# EasyEDA Pro project Project_first.eprj, schematic Schematic1
Create Date: 2024-04-23; Page Name: 485_ERR; Project Name: Project_first; Schematic Name: Schematic1; Update Date: 2024-06-17; Company: 嘉立创EDA; Page Size: A4; Version: V1.0
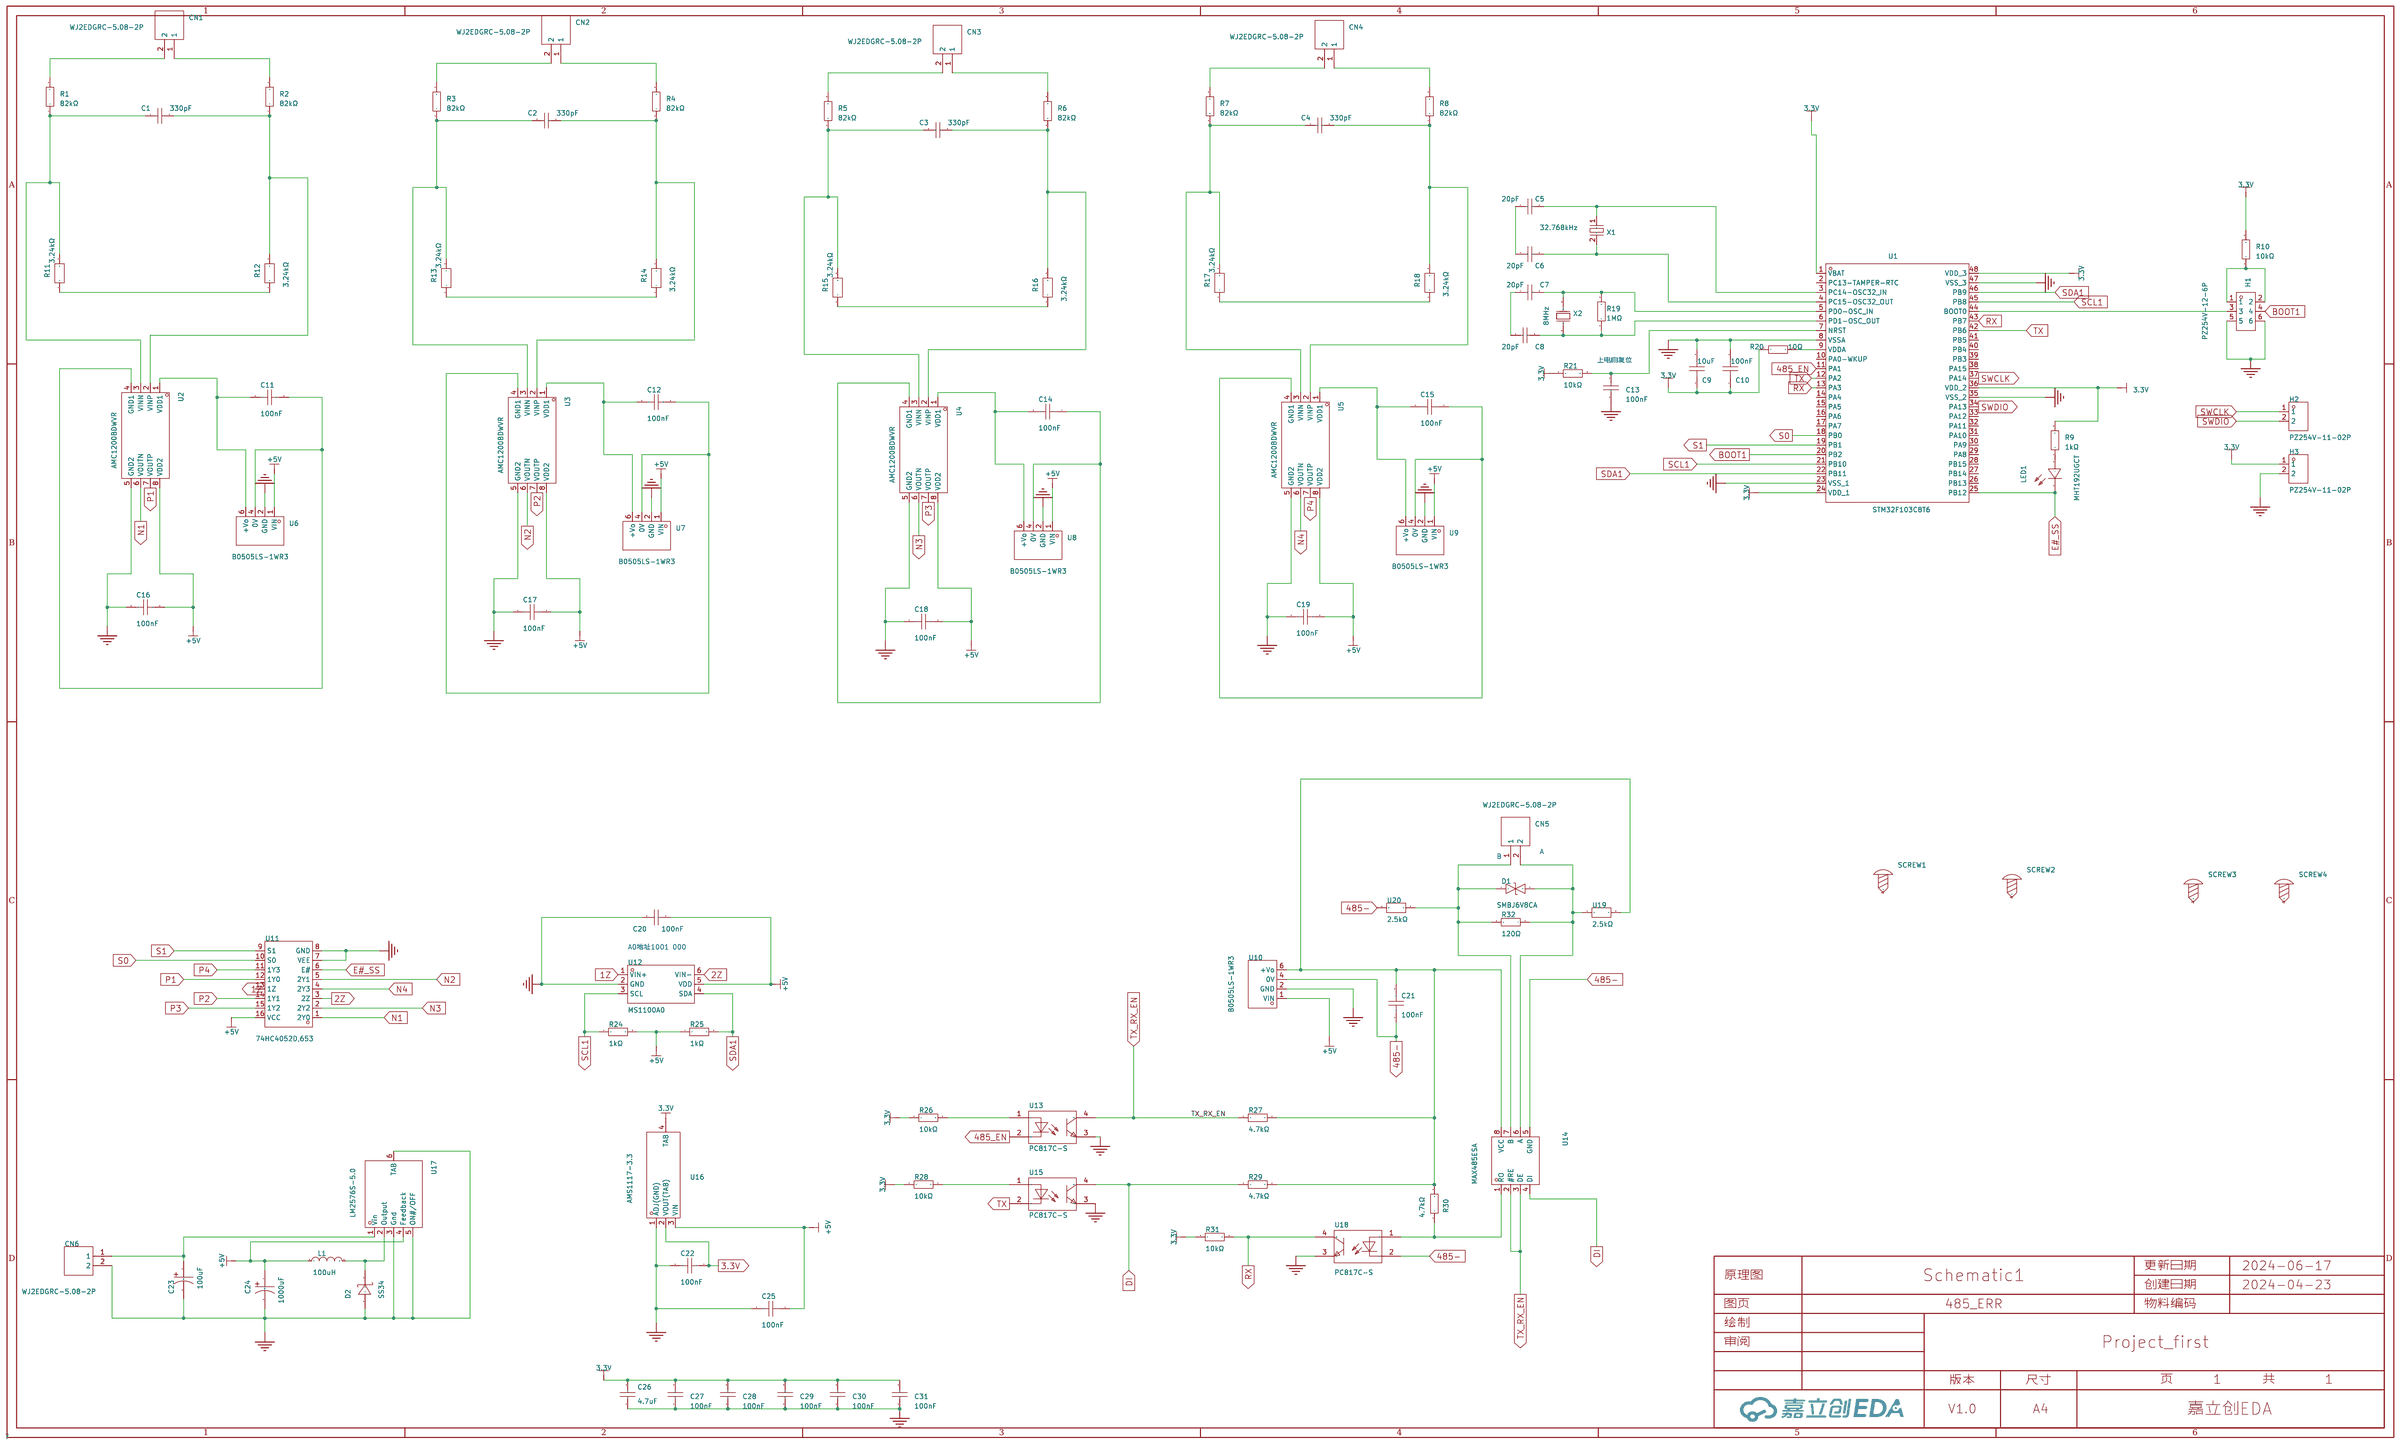
[diagram p0: schematic sheet]

## Parts
C1  330pF  [C0603]
C2  330pF  [C0603]
C3  330pF  [C0603]
C4  330pF  [C0603]
C5  20pF  [C0603]
C6  20pF  [C0603]
C7  20pF  [C0603]
C8  20pF  [C0603]
C9  10uF  [C0603]
C10  100nF  [C0603]
C11  100nF  [C0603]
C12  100nF  [C0603]
C13  100nF  [C0402]
C14  100nF  [C0603]
C15  100nF  [C0603]
C16  100nF  [C0603]
C17  100nF  [C0603]
C18  100nF  [C0603]
C19  100nF  [C0603]
C20  100nF  [C0402]
C21  100nF  [C0603]
C22  100nF  [C0603]
C23  100uF  [CAP-TH_BD8.0-P3.50-D0.6-FD]
C24  1000uF  [CAP-TH_BD10.0-P5.00-D1.0-FD]
C25  100nF  [C0603]
C26  4.7uF  [C0603]
C27  100nF  [C0402]
C28  100nF  [C0402]
C29  100nF  [C0402]
C30  100nF  [C0402]
C31  100nF  [C0402]
CN1  WJ2EDGRC-5.08-2P  [CONN-TH_2P-P5.08_WJ2EDGRC-5.08-2P]
CN2  WJ2EDGRC-5.08-2P  [CONN-TH_2P-P5.08_WJ2EDGRC-5.08-2P]
CN3  WJ2EDGRC-5.08-2P  [CONN-TH_2P-P5.08_WJ2EDGRC-5.08-2P]
CN4  WJ2EDGRC-5.08-2P  [CONN-TH_2P-P5.08_WJ2EDGRC-5.08-2P]
CN5  WJ2EDGRC-5.08-2P  [CONN-TH_2P-P5.08_WJ2EDGRC-5.08-2P]
CN6  WJ2EDGRC-5.08-2P  [CONN-TH_2P-P5.08_WJ2EDGRC-5.08-2P]
D1  SMBJ6V8CA  [SMB_L4.6-W3.6-LS5.3-BI]
D2  SS34  [SMA_L4.3-W2.6-LS5.2-RD]
H1  PZ254V-12-6P  [HDR-TH_6P-P2.54-V-M-R2-C3-S2.54]
H2  PZ254V-11-02P  [HDR-TH_2P-P2.54-V-M]
H3  PZ254V-11-02P  [HDR-TH_2P-P2.54-V-M]
L1  100uH  [IND-SMD_L7.3-W7.3-1]
LED1  MHT192UGCT  [LED0603-RD_GREEN]
R1  82kΩ  [R1206]
R2  82kΩ  [R1206]
R3  82kΩ  [R1206]
R4  82kΩ  [R1206]
R5  82kΩ  [R1206]
R6  82kΩ  [R1206]
R7  82kΩ  [R1206]
R8  82kΩ  [R1206]
R9  1kΩ  [R0805]
R10  10kΩ  [R0805]
R11  3.24kΩ  [R1206]
R12  3.24kΩ  [R1206]
R13  3.24kΩ  [R1206]
R14  3.24kΩ  [R1206]
R15  3.24kΩ  [R1206]
R16  3.24kΩ  [R1206]
R17  3.24kΩ  [R1206]
R18  3.24kΩ  [R1206]
R19  1MΩ  [R0603]
R20  10Ω  [R0603]
R21  10kΩ  [R0805]
R24  1kΩ  [R0805]
R25  1kΩ  [R0805]
R26  10kΩ  [R0805]
R27  4.7kΩ  [R0603]
R28  10kΩ  [R0805]
R29  4.7kΩ  [R0603]
R30  4.7kΩ  [R0603]
R31  10kΩ  [R0805]
R32  120Ω  [R0603]
SCREW1  -  [M3螺丝]
SCREW2  -  [M3螺丝]
SCREW3  -  [M3螺丝]
SCREW4  -  [M3螺丝]
U1  STM32F103C8T6  [LQFP-48_L7.0-W7.0-P0.50-LS9.0-BL]
U2  AMC1200BDWVR  [SOIC-8_L5.9-W7.5-P1.27-LS11.5-BL]
U3  AMC1200BDWVR  [SOIC-8_L5.9-W7.5-P1.27-LS11.5-BL]
U4  AMC1200BDWVR  [SOIC-8_L5.9-W7.5-P1.27-LS11.5-BL]
U5  AMC1200BDWVR  [SOIC-8_L5.9-W7.5-P1.27-LS11.5-BL]
U6  B0505LS-1WR3  [PWRM-TH_BXXXXLS-1WR3]
U7  B0505LS-1WR3  [PWRM-TH_BXXXXLS-1WR3]
U8  B0505LS-1WR3  [PWRM-TH_BXXXXLS-1WR3]
U9  B0505LS-1WR3  [PWRM-TH_BXXXXLS-1WR3]
U10  B0505LS-1WR3  [PWRM-TH_BXXXXLS-1WR3]
U11  74HC4052D,653  [SOIC-16_L9.9-W3.9-P1.27-LS6.0-BL]
U12  MS1100A0  [SOT-23-6_L2.9-W1.6-P0.95-LS2.8-BR]
U13  PC817C-S  [SOP-4_L6.5-W4.6-P2.54-LS10.3-TL]
U14  MAX485ESA  [SOP-8_L5.0-W4.0-P1.27-LS6.0-BL]
U15  PC817C-S  [SOP-4_L6.5-W4.6-P2.54-LS10.3-TL]
U16  AMS1117-3.3  [SOT-223-4_L6.5-W3.5-P2.30-LS7.0-BR]
U17  LM2576S-5.0  [TO-263-5_L10.2-W8.9-P1.70-BR]
U18  PC817C-S  [SOP-4_L6.5-W4.6-P2.54-LS10.3-TL]
U19  2.5kΩ  [R0805]
U20  2.5kΩ  [R0805]
X1  32.768kHz  [CRYSTAL-SMD_L3.2-W1.5-1]
X2  8MHz  [OSC-TH_L10.0-W4.5-P5.00]

## Library data of the parts
C1-C4 = 0603B331K500NT: 容值:330pF;精度:±10%;额定电压:50V;材质(温度系数):X7R;; LCSC Part Name: 330pF ±10% 50V; Supplier Part: C1612; Manufacturer: FH(风华); Supplier Footprint: 0603; JLCPCB Part Class: Extended Part; Datasheet: https://atta.szlcsc.com/upload/public/pdf/source/20200305/C486355_26A10D38EF8C2A5C37091D0039909270.pdf; Supplier: LCSC; Tolerance: ±10%; Voltage Rated: 50V; Temperature Coefficient: X7R; Check: true
C5-C8 = CC0603JRNPO9BN200: 容值:20pF;精度:±5%;额定电压:50V;材质(温度系数):NP0;; LCSC Part Name: 20pF ±5% 50V; Supplier Part: C105621; Manufacturer: YAGEO(国巨); Supplier Footprint: 0603; JLCPCB Part Class: Extended Part; Datasheet: https://atta.szlcsc.com/upload/public/pdf/source/20170505/1493957838062.pdf; Supplier: LCSC; Tolerance: ±5%; Voltage Rated: 50V; Temperature Coefficient: NP0; Check: true
C9 = CL10A106KP8NNNC: 容值:10uF;精度:±10%;额定电压:10V;材质(温度系数):X5R;; LCSC Part Name: 10uF ±10% 10V; Supplier Part: C19702; Manufacturer: SAMSUNG(三星); Supplier Footprint: 0603; JLCPCB Part Class: Basic Part; Datasheet: https://atta.szlcsc.com/upload/public/pdf/source/20160218/1457707763339.pdf; Supplier: LCSC; Tolerance: ±10%; Voltage Rated: 10V; Temperature Coefficient: X5R; Check: true
C10-C12 C14-C19 C21 C22 C25 = CC0603KRX7R9BB104: 容值:100nF;精度:±10%;额定电压:50V;材质(温度系数):X7R;; LCSC Part Name: 100nF ±10% 50V; Supplier Part: C14663; Manufacturer: YAGEO(国巨); Supplier Footprint: 0603; JLCPCB Part Class: Basic Part; Datasheet: https://atta.szlcsc.com/upload/public/pdf/source/20180910/C282072_33301C7F631E79921B82A8DAC6BCC5B3.pdf; Supplier: LCSC; Tolerance: ±10%; Voltage Rated: 50V; Temperature Coefficient: X7R; Check: true
C13 C20 C27-C31 = CL05B104KO5NNNC: 容值:100nF;精度:±10%;额定电压:16V;材质(温度系数):X7R;; LCSC Part Name: 100nF ±10% 16V; Supplier Part: C1525; Manufacturer: SAMSUNG(三星); Supplier Footprint: 0402; JLCPCB Part Class: Basic Part; Datasheet: https://atta.szlcsc.com/upload/public/pdf/source/20160218/1457707763339.pdf; Supplier: LCSC; Tolerance: ±10%; Voltage Rated: 16V; Temperature Coefficient: X7R; Check: true
C23 = LKMD1401K101MF: 容值:100uF;精度:±20%;额定电压:80V;纹波电流:735mA@100kHz;等效串联电阻:210mΩ@100kHz;; LCSC Part Name: 100uF ±20% 80V; Supplier Part: C443069; Manufacturer: Ymin(永铭); Supplier Footprint: 插件,D8xL14mm; JLCPCB Part Class: Extended Part; Datasheet: https://atta.szlcsc.com/upload/public/pdf/source/20200220/C487520_443A40905984A455D375EE990FEAA9E8.pdf; Supplier: LCSC; Tolerance: ±20%; Rated Voltage: 80V; Ripple Current: 735mA@100kHz; Equivalent Series Resistance(ESR): 210mΩ@100kHz; Lead Spacing: 3.5mm; φD: 8mm; L: 14mm; Lifetime @ Temp: 10000hrs@105℃; Check: true
C24 = RC025M102LO10*16TH-2A1E: 容值:1000uF;精度:±20%;额定电压:25V;纹波电流:1.45A@100kHz;; LCSC Part Name: 1000uF ±20% 25V; Supplier Part: C357640; Manufacturer: BERYL(绿宝石); Supplier Footprint: 插件,D10xL16mm; JLCPCB Part Class: Extended Part; Datasheet: https://atta.szlcsc.com/upload/public/pdf/source/20190116/C365813_D032970E50E497412ED095DEE828BCD0.pdf; Supplier: LCSC; Tolerance: ±20%; Rated Voltage: 25V; Ripple Current: 1.45A@100kHz; Lead Spacing: 5mm; φD: 10mm; L: 16mm; Lifetime @ Temp: 3000hrs@105℃; Operating Temperature: -40℃~+105℃; Check: true
C26 = CL10A475KO8NNNC: 容值:4.7uF;精度:±10%;额定电压:16V;材质(温度系数):X5R;; LCSC Part Name: 4.7uF ±10% 16V; Supplier Part: C19666; Manufacturer: SAMSUNG(三星); Supplier Footprint: 0603; JLCPCB Part Class: Basic Part; Datasheet: https://atta.szlcsc.com/upload/public/pdf/source/20160218/1457707763339.pdf; Supplier: LCSC; Tolerance: ±10%; Voltage Rated: 16V; Temperature Coefficient: X5R; Check: true
CN1-CN6 = WJ2EDGRC-5.08-2P: 连接器类型:板端/插座-闭口;结构:1x2P;间距:5.08mm;颜色:绿色;安装方式:弯针;排数:1;每排PIN数:2;; LCSC Part Name: 5.08mm 1x2P 排数:1 每排P数:2; Supplier Part: C3697; Manufacturer: KANGNEX(康奈克斯电气); Supplier Footprint: 弯插,P=5.08mm; JLCPCB Part Class: Extended Part; Datasheet: https://atta.szlcsc.com/upload/public/pdf/source/20191225/C3697_6E7B45CD3FD3DA2CDF6A2CE707235E10.pdf; Supplier: LCSC; Connector Type: 板端/插座-闭口; Structure: 1x2P; Pitch: 5.08mm; Color: 绿色; Mounting Style: 弯针; Number of Pins: 2P; Number of Rows: 1; Number of PINs Per Row: 2; Check: true
D1 = SMBJ6V8CA: 反向截止电压(Vrwm):5.8V;最大钳位电压:10.5V;峰值脉冲电流(Ipp)@10/1000us:58.1A;击穿电压:6.45V;; Supplier Part: C2898386; Manufacturer: YFW(佑风微); Supplier Footprint: SMB; JLCPCB Part Class: Extended Part; Datasheet: https://atta.szlcsc.com/upload/public/pdf/source/20211015/3F0F614323A7DEE21FE970DA19A2B927.pdf; Supplier: LCSC; Reverse Stand-Off Voltage (Vrwm): 5.8V; Maximum Clamping Voltage: 10.5V; Peak Pulse Current (Ipp)@10/1000us: 58.1A; Breakdown Voltage: 6.45V; Reverse Leakage Current (Ir): 1mA; Type: TVS; Check: true
D2 = SS34_C8678: 二极管配置:独立式;正向压降(Vf):550mV@3A;直流反向耐压(Vr):40V;平均整流电流(Io):3A;; LCSC Part Name: 电压:40V 电流:3A; Supplier Part: C8678; Manufacturer: MDD; Supplier Footprint: SMA(DO-214AC); JLCPCB Part Class: Basic Part; Datasheet: https://atta.szlcsc.com/upload/public/pdf/source/20230314/A80AE34493C69B89E2F4B1712F433538.pdf; Supplier: LCSC; Diode Configuration: 独立式; Forward Voltage (Vf@If): 550mV@3A; Reverse Voltage (Vr): 40V; Average Rectified Current (Io): 3A; Reverse Leakage Current (Ir): 500uA@40V; Check: true
H1 = PZ254V-12-6P: 插针结构:2x3P;间距:2.54mm;行距:2.54mm;圆针/方针:方针;安装类型:直插;排数:双排;总PIN位数:6P;额定电流:-;额定电压:-;配合针长度:6mm;塑高:2.5mm;端接针长度:3mm;触头材质:黄铜;触头镀层:-;工作温度范围:-40℃~+105℃;颜色:黑色;; LCSC Part Name: 间距:2.54mm 2x3P 直插 方针; Supplier Part: C492420; Manufacturer: XFCN(兴飞); Supplier Footprint: 插件,P=2.54mm; JLCPCB Part Class: Extended Part; Datasheet: https://atta.szlcsc.com/upload/public/pdf/source/20200309/C492420_BAECB307B001054C09D200388220EAE6.pdf; Supplier: LCSC; Pin Structure: 2x3P; Pitch: 2.54mm; Row Spacing: 2.54mm; Circluar Pins/Square Pins: 方针; Mounting Type: 直插; Number of Rows: 双排; Number of Pins: 6P; Length of Mating Pin: 6mm; Insulation Height: 2.5mm; Length of End Connection Pin: 3mm; Contact Material: 黄铜; Operating Temperature Range: -40℃~+105℃; Color: 黑色; Check: true
H2 H3 = PZ254V-11-02P: 插针结构:1x2P;间距:2.54mm;行距:-;圆针/方针:方针;安装类型:直插;排数:单排;总PIN位数:2P;额定电流:-;额定电压:-;配合针长度:6mm;塑高:2.5mm;端接针长度:3mm;触头材质:黄铜;触头镀层:-;工作温度范围:-40℃~+105℃;颜色:黑色;; LCSC Part Name: 间距:2.54mm 1x2P 直插 方针; Supplier Part: C492401; Manufacturer: XFCN(兴飞); Supplier Footprint: 插件,P=2.54mm; JLCPCB Part Class: Extended Part; Datasheet: https://atta.szlcsc.com/upload/public/pdf/source/20200309/C492401_A812433581A9B211A7FFA413ADDFF0E5.pdf; Supplier: LCSC; Pin Structure: 1x2P; Pitch: 2.54mm; Circluar Pins/Square Pins: 方针; Mounting Type: 直插; Number of Rows: 单排; Number of Pins: 2P; Length of Mating Pin: 6mm; Insulation Height: 2.5mm; Length of End Connection Pin: 3mm; Contact Material: 黄铜; Operating Temperature Range: -40℃~+105℃; Color: 黑色; Check: true
L1 = YPRH0704-101M: 电感值:100uH;精度:±20%;额定电流:600mA;; LCSC Part Name: 100uH ±20%; Supplier Part: C514812; Manufacturer: YJYCOIN(益嘉源); Supplier Footprint: SMD,7.3x7.3mm; JLCPCB Part Class: Extended Part; Datasheet: https://atta.szlcsc.com/upload/public/pdf/source/20200415/C514805_A0DEE7A5C2CBBD84C043B11E55CA01C7.pdf; Supplier: LCSC; Tolerance: ±20%; Rated Current: 600mA; DC Resistance (DCR): 610mΩ; Check: true
LED1 = MHT192UGCT: 发光颜色:翠绿色;功率:60mW;正向电流:20mA;主波长:515nm~530nm;二极管配置:-;透镜颜色:无色透明透镜;色温:-;发光角度:120°;载带方式:-;工作温度:-40℃~+85℃;; LCSC Part Name: 翠绿; Supplier Part: C389519; Manufacturer: MEIHUA(美华); Supplier Footprint: 0603; JLCPCB Part Class: Extended Part; Datasheet: https://atta.szlcsc.com/upload/public/pdf/source/20190515/C389519_7BC27E831414348C8AF19AF18EE4BF58.pdf; Supplier: LCSC; Emitted Color: 翠绿色; Power Dissipation: 60mW; Forward Current: 20mA; Dominant Wavelength: 515nm~530nm; Peak Wavelength: 518nm; Lens Color: 无色透明透镜; Viewing Angle: 120°; Operating Temperature: -40℃~+85℃; Check: true
R1-R8 = 1206W4F8202T5E: 电阻类型:厚膜电阻;阻值:82kΩ;精度:±1%;功率:250mW;最大工作电压:200V;温度系数:±100ppm/℃;; LCSC Part Name: 82kΩ ±1% 250mW 厚膜电阻; Supplier Part: C17979; Manufacturer: UNI-ROYAL(厚声); Supplier Footprint: 1206; JLCPCB Part Class: Extended Part; Datasheet: https://atta.szlcsc.com/upload/public/pdf/source/20200306/C422600_1E6D84923E4A46A82E41ADD87F860B5C.pdf; Supplier: LCSC; Type: 厚膜电阻; Tolerance: ±1%; Power(Watts): 250mW; Overload Voltage (Max): 200V; Temperature Coefficient: ±100ppm/℃; Operating Temperature Range: -55℃~+155℃; Check: true
R9 R24 R25 = 0805W8F1001T5E: 电阻类型:厚膜电阻;阻值:1kΩ;精度:±1%;功率:125mW;最大工作电压:150V;温度系数:±100ppm/℃;; LCSC Part Name: 1kΩ ±1% 125mW 厚膜电阻; Supplier Part: C17513; Manufacturer: UNI-ROYAL(厚声); Supplier Footprint: 0805; JLCPCB Part Class: Basic Part; Datasheet: https://atta.szlcsc.com/upload/public/pdf/source/20200306/C422600_1E6D84923E4A46A82E41ADD87F860B5C.pdf; Supplier: LCSC; Type: 厚膜电阻; Tolerance: ±1%; Power(Watts): 125mW; Overload Voltage (Max): 150V; Temperature Coefficient: ±100ppm/℃; Operating Temperature Range: -55℃~+155℃; Check: true
R10 R21 R26 R28 R31 = 0805W8F1002T5E_C17414: 电阻类型:厚膜电阻;阻值:10kΩ;精度:±1%;功率:125mW;最大工作电压:150V;温度系数:±100ppm/℃;; LCSC Part Name: 10kΩ ±1% 125mW 厚膜电阻; Supplier Part: C17414; Manufacturer: UNI-ROYAL(厚声); Manufacturer Part: 0805W8F1002T5E; Supplier Footprint: 0805; JLCPCB Part Class: Basic Part; Datasheet: https://atta.szlcsc.com/upload/public/pdf/source/20200306/C422600_1E6D84923E4A46A82E41ADD87F860B5C.pdf; Supplier: LCSC; Type: 厚膜电阻; Tolerance: ±1%; Power(Watts): 125mW; Overload Voltage (Max): 150V; Temperature Coefficient: ±100ppm/℃; Operating Temperature Range: -55℃~+155℃; Check: true
R11-R18 = FRC1206F3241TS: 电阻类型:厚膜电阻;阻值:3.24kΩ;精度:±1%;功率:250mW;最大工作电压:200V;温度系数:±100ppm/℃;; LCSC Part Name: 3.24kΩ ±1% 250mW 厚膜电阻; Supplier Part: C5153989; Manufacturer: FOJAN(富捷); Supplier Footprint: 1206; JLCPCB Part Class: Extended Part; Datasheet: https://atta.szlcsc.com/upload/public/pdf/source/20211221/925EC7D7225764EE0046F22065062C87.pdf; Supplier: LCSC; Type: 厚膜电阻; Tolerance: ±1%; Power(Watts): 250mW; Overload Voltage (Max): 200V; Temperature Coefficient: ±100ppm/℃; Check: true
R19 = 0603WAF1004T5E: 电阻类型:厚膜电阻;阻值:1MΩ;精度:±1%;功率:100mW;最大工作电压:75V;温度系数:±100ppm/℃;; LCSC Part Name: 1MΩ ±1% 100mW 厚膜电阻; Supplier Part: C22935; Manufacturer: UNI-ROYAL(厚声); Supplier Footprint: 0603; JLCPCB Part Class: Basic Part; Datasheet: https://atta.szlcsc.com/upload/public/pdf/source/20200306/C422600_1E6D84923E4A46A82E41ADD87F860B5C.pdf; Supplier: LCSC; Type: 厚膜电阻; Tolerance: ±1%; Power(Watts): 100mW; Overload Voltage (Max): 75V; Temperature Coefficient: ±100ppm/℃; Operating Temperature Range: -55℃~+155℃; Check: true
R20 = 0603WAF100JT5E: 电阻类型:厚膜电阻;阻值:10Ω;精度:±1%;功率:100mW;最大工作电压:75V;温度系数:±400ppm/℃;; LCSC Part Name: 10Ω ±1% 100mW 厚膜电阻; Supplier Part: C22859; Manufacturer: UNI-ROYAL(厚声); Supplier Footprint: 0603; JLCPCB Part Class: Basic Part; Datasheet: https://atta.szlcsc.com/upload/public/pdf/source/20200306/C422600_1E6D84923E4A46A82E41ADD87F860B5C.pdf; Supplier: LCSC; Type: 厚膜电阻; Tolerance: ±1%; Power(Watts): 100mW; Overload Voltage (Max): 75V; Temperature Coefficient: ±400ppm/℃; Operating Temperature Range: -55℃~+155℃; Check: true
R27 R29 R30 = 0603WAF4701T5E: 电阻类型:厚膜电阻;阻值:4.7kΩ;精度:±1%;功率:100mW;最大工作电压:75V;温度系数:±100ppm/℃;; LCSC Part Name: 4.7kΩ ±1% 100mW 厚膜电阻; Supplier Part: C23162; Manufacturer: UNI-ROYAL(厚声); Supplier Footprint: 0603; JLCPCB Part Class: Basic Part; Datasheet: https://atta.szlcsc.com/upload/public/pdf/source/20200306/C422600_1E6D84923E4A46A82E41ADD87F860B5C.pdf; Supplier: LCSC; Type: 厚膜电阻; Tolerance: ±1%; Power(Watts): 100mW; Overload Voltage (Max): 75V; Temperature Coefficient: ±100ppm/℃; Operating Temperature Range: -55℃~+155℃; Check: true
R32 = 0603WAF1200T5E: 电阻类型:厚膜电阻;阻值:120Ω;精度:±1%;功率:100mW;最大工作电压:75V;温度系数:±100ppm/℃;; LCSC Part Name: 120Ω ±1% 100mW 厚膜电阻; Supplier Part: C22787; Manufacturer: UNI-ROYAL(厚声); Supplier Footprint: 0603; JLCPCB Part Class: Basic Part; Datasheet: https://atta.szlcsc.com/upload/public/pdf/source/20200306/C422600_1E6D84923E4A46A82E41ADD87F860B5C.pdf; Supplier: LCSC; Type: 厚膜电阻; Tolerance: ±1%; Power(Watts): 100mW; Overload Voltage (Max): 75V; Temperature Coefficient: ±100ppm/℃; Operating Temperature Range: -55℃~+155℃; Check: true
SCREW1-SCREW4 = M3螺丝: Supplier Footprint: 插件
U1 = STM32F103C8T6: CPU内核:CM3;程序存储容量:64KB;RAM总容量:20KB;GPIO端口数量:37;工作电压范围:2V~3.6V;CPU最大主频:72MHz;程序存储器类型:FLASH;; LCSC Part Name: STM32F103C8T6 MSL=3; Supplier Part: C8734; Manufacturer: ST(意法半导体); Supplier Footprint: LQFP-48(7x7); JLCPCB Part Class: Extended Part; Datasheet: https://atta.szlcsc.com/upload/public/pdf/source/20220812/8363ACEC51AD55ECEB84799464F7CB85.pdf; Supplier: LCSC; CPU Core: CM3; Program Storage Size: 64KB; RAM Size: 20KB; GPIO Ports Number: 37; Operating Voltage Range: 2V~3.6V; CPU Maximum Speed: 72MHz; Program Memory Type: FLASH; Operating Temperature Range: -40℃~+85℃; ADC (Bit): 12bit; Universal Serial Bus: 有; Peripheral/Function: 看门狗；DMA；看门狗；片载温度传感器; Watchdog: 有; Infrared Data Association: 有; Low-Voltage Detect: 有; Direct Memory Access: 有; Internal Oscillator: 有; Check: true
U2-U5 = AMC1200BDWVR: 放大器数:单路;-3dB带宽:100kHz;输入偏置电流(Ib):-;输入失调电压(Vos):200uV;; Supplier Part: C79905; Manufacturer: TI(德州仪器); Supplier Footprint: SOIC-8-300mil; JLCPCB Part Class: Extended Part; Datasheet: https://www.ti.com/cn/lit/gpn/amc1200; Supplier: LCSC; Number of Channels: 单路; Bandwidth (-3dB): 100kHz; Input Offset Voltage (Vos): 200uV; Operating Temperature: -40℃~+105℃; Check: true
U6-U10 = B0505LS-1WR3_C5365294: 输入电压(DC):4.5V~5.5V;输出电压:5V;输出功率:1W;输出电流(最大值):200mA;; LCSC Part Name: 直流隔离电源模块5V转5V短路保护; Supplier Part: C5365294; Manufacturer: HI-LINK(海凌科); Supplier Footprint: 插件; Supplier: LCSC; Input Voltage(DC): 4.5V~5.5V; Output Voltage: 5V; Output Power: 1W; Output Current (Max): 200mA; Isolation or not: 隔离; Insulated Voltage: 1.5kV; Feature: 短路保护; Check: true
U11 = 74HC4052D,653: 开关电路:单刀四掷(SP4T);通道数:2;导通电阻(Ron@VCC):150Ω;; LCSC Part Name: 双4通道模拟复用器 解复用器; Supplier Part: C11350; Manufacturer: Nexperia(安世); Supplier Footprint: SOIC-16; JLCPCB Part Class: Extended Part; Datasheet: https://atta.szlcsc.com/upload/public/pdf/source/20130225/1457706594415.pdf; Supplier: LCSC; Switch Circuit: 单刀四掷(SP4T); Number of Channels: 2; Supply Voltage: 2V~10V; Turn-on time: 58ns; On-State Resistance (Max): 150Ω; Turn-off time: 48ns; Check: true
U12 = MS1100A0: 接口:I2C;电源电压:2.7V~5.5V;采样率:240Hz;分辨率:16位;; LCSC Part Name: 1通道 240Hz 16位ADC I2C接口; Supplier Part: C482687; Manufacturer: 杭州瑞盟; Supplier Footprint: SOT-23-6; JLCPCB Part Class: Extended Part; Datasheet: https://atta.szlcsc.com/upload/public/pdf/source/20200115/C482687_AC1DA36C49F76E9B9AAB230F60F7F07C.pdf; Supplier: LCSC; Interface: I2C; differential input: 是; number of channels: 1; Supply Voltage: 2.7V~5.5V; sampling frequency: 240Hz; resolution: 16位; Check: true
U13 U15 U18 = PC817C-S: LCSC Part Name: 光耦; Supplier Part: C3008369; Manufacturer: UMW(友台半导体); Supplier Footprint: SOP-4-2.54mm; JLCPCB Part Class: Extended Part; Datasheet: https://atta.szlcsc.com/upload/public/pdf/source/20231109/4644CC05A9D09AF3A1056B42E9A17852.pdf; Supplier: LCSC; Check: true
U14 = MAX485ESA_C668206: Supplier Part: C668206; Manufacturer: UMW(友台半导体); Supplier Footprint: SOP-8; JLCPCB Part Class: Extended Part; Datasheet: https://atta.szlcsc.com/upload/public/pdf/source/20231109/489730AE87B90C4B6B8CE65C07B1054C.pdf; Supplier: LCSC; Check: true
U16 = AMS1117-3.3_C347222: 输出类型:固定;最大输入电压:12V;输出电压:3.3V;最大输出电流:1A;电源纹波抑制比(PSRR):60dB@(120Hz);输出极性:正极;; LCSC Part Name: 输出:3.3V 电流:1A 耐压:12V; Supplier Part: C347222; Manufacturer: UMW(友台半导体); Supplier Footprint: SOT-223; JLCPCB Part Class: Extended Part; Datasheet: https://atta.szlcsc.com/upload/public/pdf/source/20231109/155D79A26D9DB04352555A58D5969DC8.pdf; Supplier: LCSC; Output Type: 固定; Maximum Input Voltage: 12V; Output Voltage: 3.3V; MAX Output Current: 1A; Power Supply Rejection Ratio (PSRR): 60dB@(120Hz); Dropout Voltage: 1.3V@(1A); Output Polarity: 正极; Number of Outputs: 1; Check: true
U17 = LM2576S-5.0_C347413: 功能类型:降压型;输出类型:固定;输入电压:40V;输出电压:5V;输出电流(最大值):3A;; Supplier Part: C347413; Manufacturer: UMW(友台半导体); Supplier Footprint: TO-263-5; JLCPCB Part Class: Extended Part; Datasheet: https://atta.szlcsc.com/upload/public/pdf/source/20231109/97ACD99236AD6FA78302E85E1B8CCF74.pdf; Supplier: LCSC; Function: 降压型; Output Type: 固定; Input Voltage: 40V; Output Voltage: 5V; Output Current (Max): 3A; Switching Frequency: 52kHz; Operating Temperature: -40℃~+125℃@(TA); Synchronous Rectification: 是; Number of Outputs: 1; Topology: 降压式; Switch tube (built-in/external): 内置; Check: true
U19 U20 = FRQ0805F2501TS: 电阻类型:厚膜电阻;阻值:2.5kΩ;精度:±1%;功率:125mW;最大工作电压:150V;温度系数:±100ppm/℃;; LCSC Part Name: 2.5kΩ ±1% 125mW 厚膜电阻; Supplier Part: C5713447; Manufacturer: FOJAN(富捷); Supplier Footprint: 0805; JLCPCB Part Class: Extended Part; Datasheet: https://atta.szlcsc.com/upload/public/pdf/source/20211221/925EC7D7225764EE0046F22065062C87.pdf; Supplier: LCSC; Type: 厚膜电阻; Tolerance: ±1%; Power(Watts): 125mW; Overload Voltage (Max): 150V; Temperature Coefficient: ±100ppm/℃; Check: true
X1 = H31003271C2070CY: 晶振类型:贴片晶振;频率:32.768kHz;常温频差:±20ppm;外接负载电容:12.5pF;频率稳定度(全温):±30ppm;; LCSC Part Name: 32.768kHz ±20ppm 12.5pF; Supplier Part: C5361379; Manufacturer: JGHC(晶光华); Supplier Footprint: SMD3215-2P; JLCPCB Part Class: Extended Part; Datasheet: https://atta.szlcsc.com/upload/public/pdf/source/20240223/DA6BB0D04F2F206220D58296EAF6160A.pdf; Supplier: LCSC; Crystal Type: 贴片晶振; Normal temperature Frequency Tolerance: ±20ppm; External load capacitor: 12.5pF; Frequency Stability(Full temperature range): ±30ppm; Equivalent Series Resistance (ESR): 70kΩ; Operating Temperature: -40℃~+85℃; Check: true
X2 = X49SD8MSD2SC: 晶振类型:直插晶振;频率:8MHz;常温频差:±20ppm;外接负载电容:20pF;频率稳定度(全温):±30ppm;; LCSC Part Name: 8MHz ±20ppm 20pF; Supplier Part: C21263; Manufacturer: YXC(扬兴晶振); Supplier Footprint: HC-49S; JLCPCB Part Class: Extended Part; Datasheet: https://atta.szlcsc.com/upload/public/pdf/source/20240329/977D7F2434F98B2BE33270BB9FF3D86D.pdf; Supplier: LCSC; Crystal Type: 直插晶振; Normal temperature Frequency Tolerance: ±20ppm; External load capacitor: 20pF; Frequency Stability(Full temperature range): ±30ppm; Operating Temperature: -20℃~+70℃; Check: true

## Nets
3.3V: C9.1 C10.1 C22.1 C26.2 C27.2 C28.2 C29.2 C30.2 C31.2 H3.1 R9.2 R10.2 R20.1 R21.1 R26.1 R28.1 R31.1 U1.1(VBAT) U1.24(VDD_1) U1.36(VDD_2) U1.48(VDD_3) U16.2(VOUT(TAB)) U16.4(TAB)
+5V: C16.1 C17.2 C18.2 C19.2 C20.1 C24.1 C25.1 L1.1 R24.2 R25.1 U2.8(VDD2) U3.8(VDD2) U4.8(VDD2) U5.8(VDD2) U6.1(VIN) U7.1(VIN) U8.1(VIN) U9.1(VIN) U10.1(VIN) U11.16(VCC) U12.5(VDD) U16.3(VIN) U17.4(Feedback)
GND: C9.2 C10.2 C13.1 C16.2 C17.1 C18.1 C19.1 C20.2 C22.2 C23.2 C24.2 C25.2 C26.1 C27.1 C28.1 C29.1 C30.1 C31.1 CN6.2 D2.2(A) H1.5 H1.6 H3.2 U1.8(VSSA) U1.23(VSS_1) U1.35(VSS_2) U1.47(VSS_3) U2.5(GND2) U3.5(GND2) U4.5(GND2) U5.5(GND2) U6.2(GND) U7.2(GND) U8.2(GND) U9.2(GND) U10.2(GND) U11.7(VEE) U11.8(GND) U12.2(GND) U13.3(EM) U15.3(EM) U16.1(ADJ(GND)) U17.3(Gnd) U17.5(ON#/OFF) U17.6(TAB) U18.3(EM)
1Z: U11.13(1Z) U12.1(VIN+)
2Z: U11.3(2Z) U12.6(VIN-)
485-: C21.1 U10.4(0V) U14.5(GND) U18.2(CAT) U20.2
485_EN: U1.11(PA1) U13.2(CAT)
BOOT1: H1.4 U1.20(PB2)
DI: R29.1 U14.4(DI) U15.4(COL)
E#_SS: LED1.1(-) U1.25(PB12) U11.6(E#)
N1: U2.6(VOUTN) U11.1(2Y0)
N2: U3.6(VOUTN) U11.5(2Y1)
N3: U4.6(VOUTN) U11.2(2Y2)
N4: U5.6(VOUTN) U11.4(2Y3)
P1: U2.7(VOUTP) U11.12(1Y0)
P2: U3.7(VOUTP) U11.14(1Y1)
P3: U4.7(VOUTP) U11.15(1Y2)
P4: U5.7(VOUTP) U11.11(1Y3)
RX: R31.2 U1.13(PA3) U1.43(PB7) U18.4(COL)
S0: U1.18(PB0) U11.10(S0)
S1: U1.19(PB1) U11.9(S1)
SCL1: R24.1 U1.21(PB10) U1.45(PB8) U12.3(SCL)
SDA1: R25.2 U1.22(PB11) U1.46(PB9) U12.4(SDA)
SWCLK: H2.1 U1.37(PA14)
SWDIO: H2.2 U1.34(PA13)
TX: U1.12(PA2) U1.42(PB6) U15.2(CAT)
TX_RX_EN: R27.1 U13.4(COL) U14.2(#RE) U14.3(DE)
$1N3120: C1.1 R1.1 R11.2 U2.3(VINN)
$1N3149: C1.2 R2.1 R12.2 U2.2(VINP)
$1N7559: D2.1(K) L1.2 U17.2(Output)
$1N13616: C7.1 C8.1
$1N13634: C5.1 C6.1
$1N13645: C7.2 R19.2 U1.5(PD0-OSC_IN) X2.1(OSC1)
$1N13656: C8.2 R19.1 U1.6(PD1-OSC_OUT) X2.2(OSC2)
$1N13679: C5.2 U1.3(PC14-OSC32_IN) X1.1
$1N13686: C6.2 U1.4(PC15-OSC32_OUT) X1.2(GND)
$1N13854: C13.2 R21.2 U1.7(NRST)
$1N15048: R20.2 U1.9(VDDA)
$1N15399: H1.3 U1.44(BOOT0)
$1N15571: H1.1 H1.2 R10.1
$1N15993: LED1.2(+) R9.1
$1N17819: R30.1 U14.1(RO) U18.1(AN)
$1N18155: R26.2 U13.1(AN)
$1N18206: R28.2 U15.1(AN)
$1N19459: CN1.2 R1.2
$1N19465: CN1.1 R2.2
$1N19606: R11.1 R12.1
$1N19609: C11.2 U2.1(VDD1) U6.6(+Vo)
$1N19618: C11.1 U2.4(GND1) U6.4(0V)
$1N20071: C2.1 R3.1 R13.2 U3.3(VINN)
$1N20080: C2.2 R4.1 R14.2 U3.2(VINP)
$1N20104: CN2.2 R3.2
$1N20107: CN2.1 R4.2
$1N20110: R13.1 R14.1
$1N20112: C12.2 U3.1(VDD1) U7.6(+Vo)
$1N20120: C12.1 U3.4(GND1) U7.4(0V)
$1N20580: C3.1 R5.1 R15.2 U4.3(VINN)
$1N20589: C3.2 R6.1 R16.2 U4.2(VINP)
$1N20613: CN3.2 R5.2
$1N20616: CN3.1 R6.2
$1N20619: R15.1 R16.1
$1N20621: C14.2 U4.1(VDD1) U8.6(+Vo)
$1N20629: C14.1 U4.4(GND1) U8.4(0V)
$1N21089: C4.1 R7.1 R17.2 U5.3(VINN)
$1N21098: C4.2 R8.1 R18.2 U5.2(VINP)
$1N21122: CN4.2 R7.2
$1N21125: CN4.1 R8.2
$1N21128: R17.1 R18.1
$1N21130: C15.2 U5.1(VDD1) U9.6(+Vo)
$1N21138: C15.1 U5.4(GND1) U9.4(0V)
$1N51201: C23.1 CN6.1 U17.1(Vin)
$1N54311: CN5.1 D1.1 R32.2 U14.7(B) U20.1
$1N54342: CN5.2 D1.2 R32.1 U14.6(A) U19.1
$1N54555: C21.2 R27.2 R29.2 R30.2 U10.6(+Vo) U14.8(VCC) U19.2

Not connected (* = marked no-connect by the designer): SCREW1 1; SCREW2 1; SCREW3 1; SCREW4 1; U1 2(PC13-TAMPER-RTC) 10(PA0-WKUP) 14(PA4) 15(PA5) 16(PA6) 17(PA7) 26(PB13) 27(PB14) 28(PB15) 29(PA8) 30(PA9) 31(PA10) 32(PA11) 33(PA12) 38(PA15) 39(PB3) 40(PB4) 41(PB5)

## Notes on the sheet
- 上电自复位
- A
- B
- A0地址1001 000
